# EasyEDA Pro project BLDCv5.eprj, schematic Schematic2_1
Board Name: SPDV4_THT; Create Date: 2024-11-05; Page Name: P1; Project Name: BLDCv5; Schematic Name: Schematic2_1; Update Date: 2024-12-21; Company: EasyEDA.com; Drawn: EasyEDA; Page Size: A4; Part Number: JLCPCB-002; Reviewed: EasyEDA; Version: V0.1
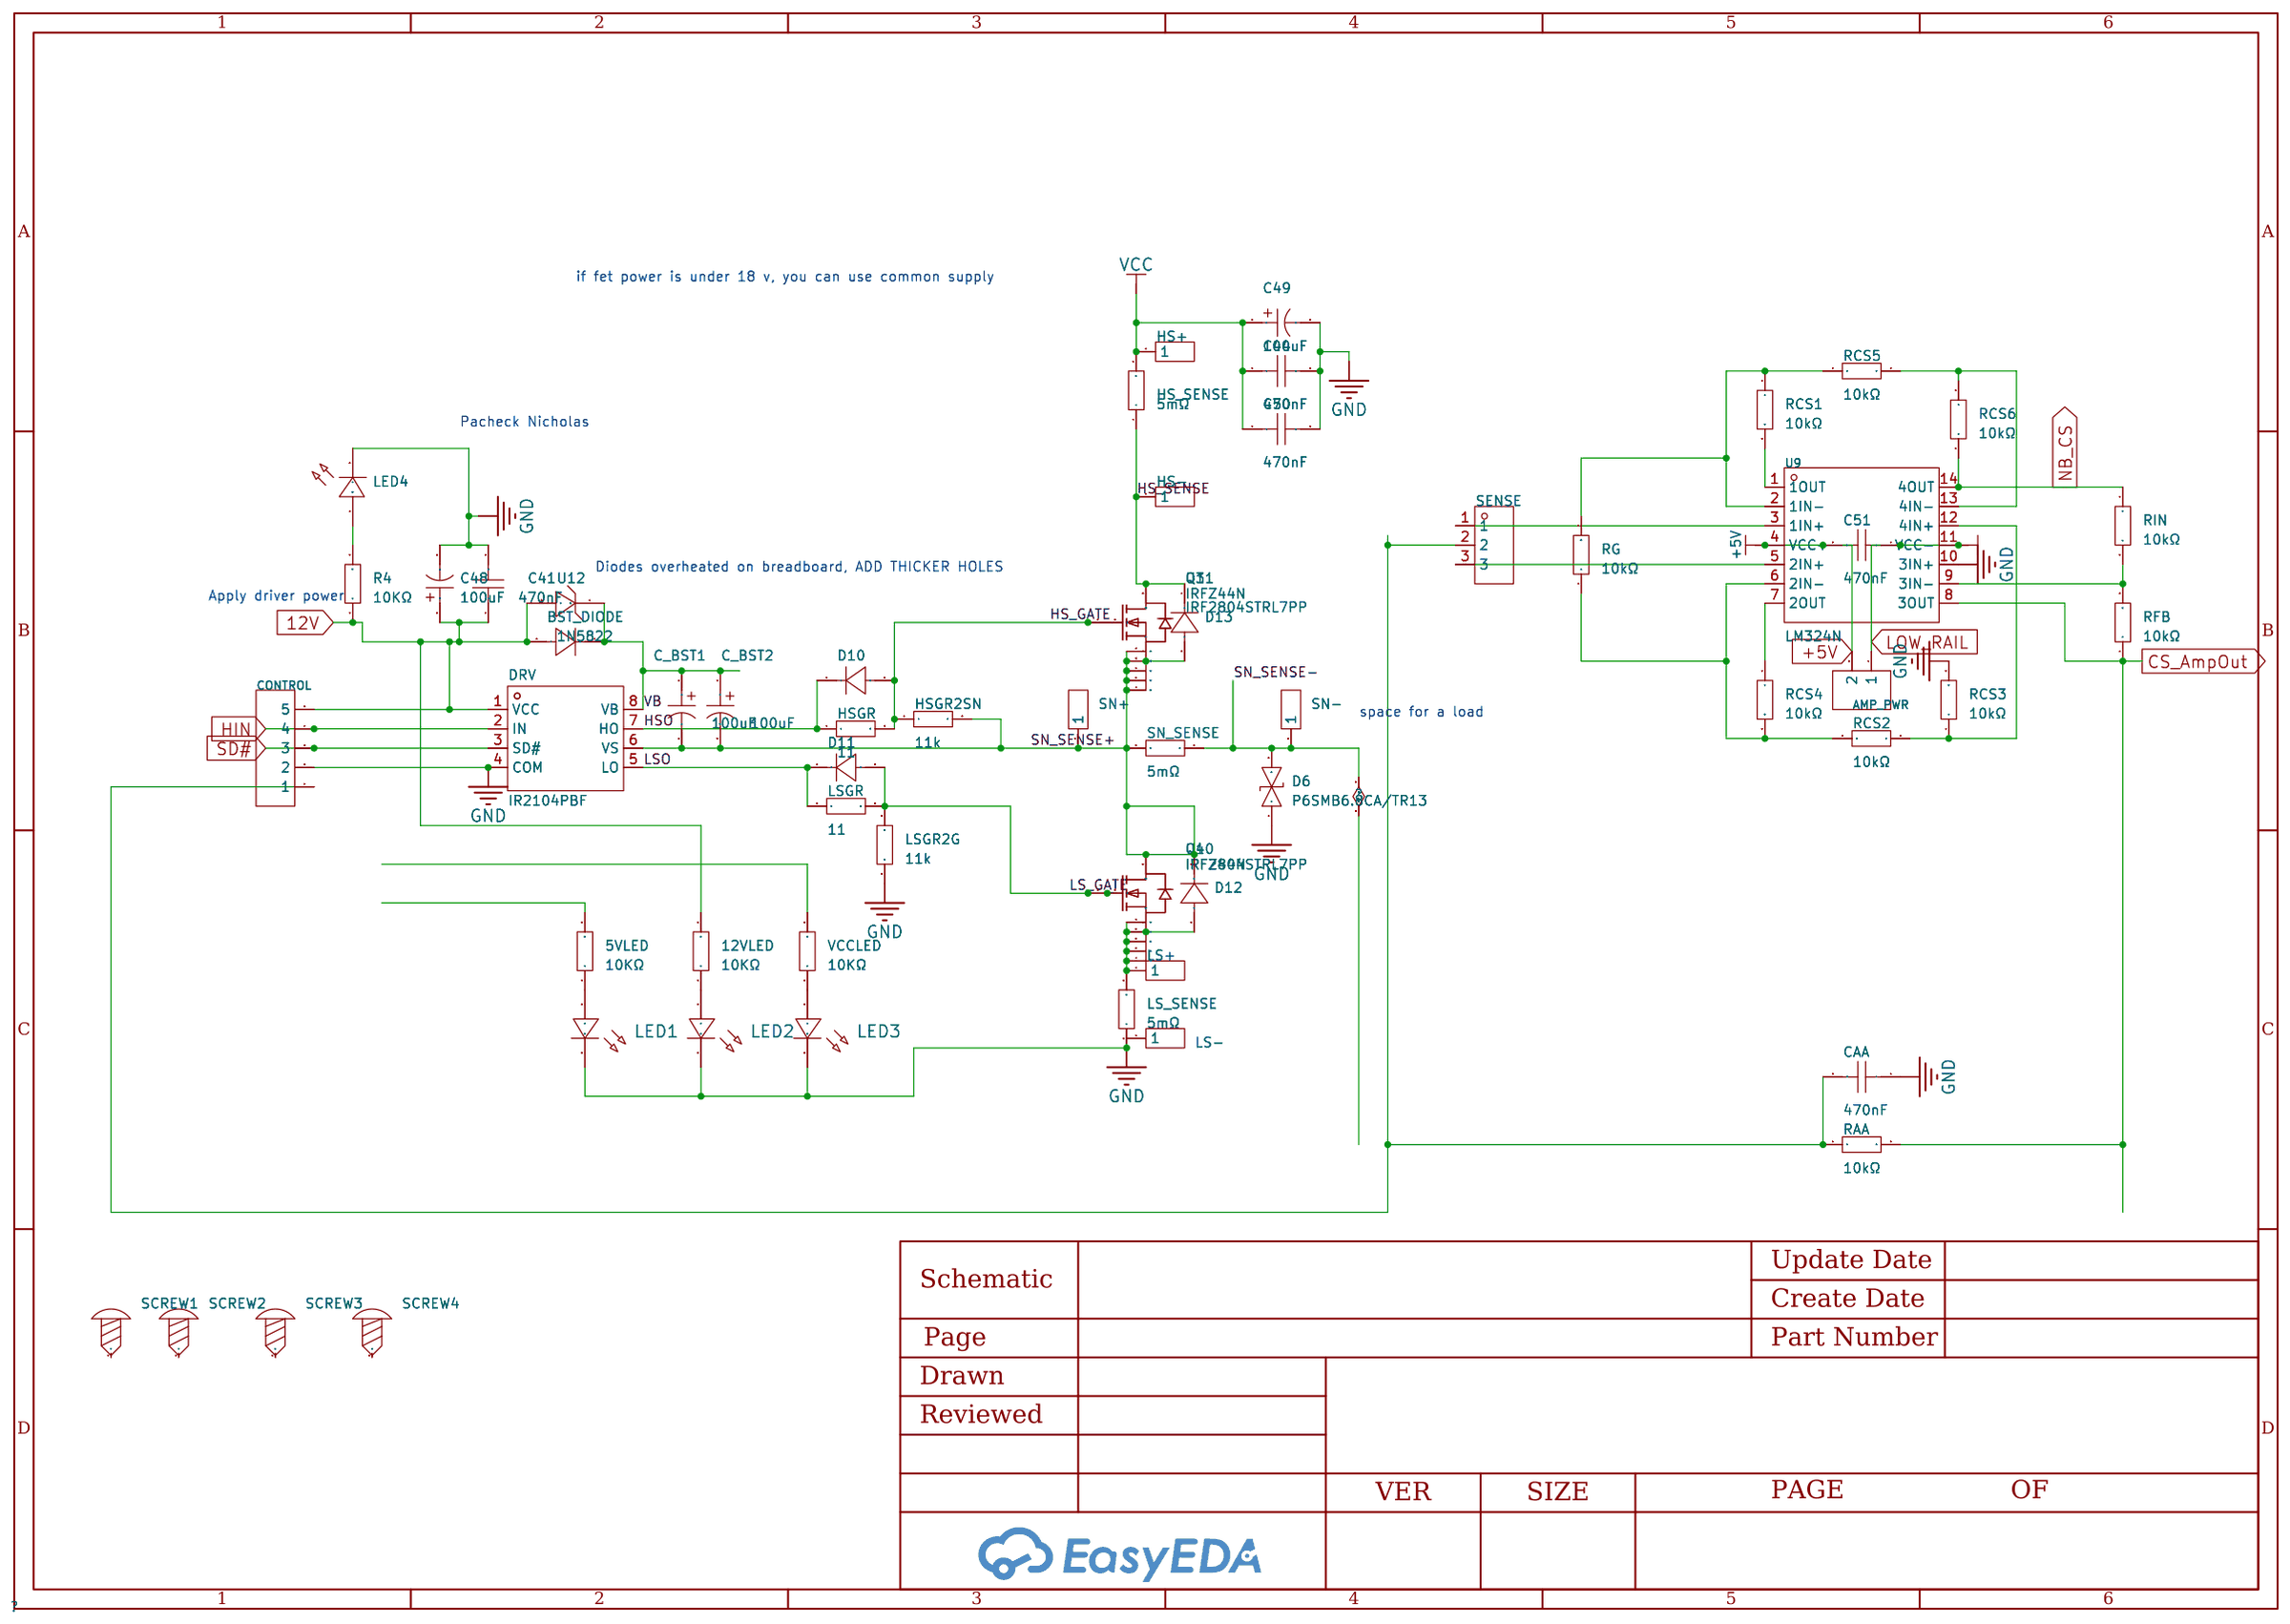
[diagram p4: schematic sheet]

## Parts
5VLED  10KΩ  [R1210]
12VLED  10KΩ  [R1210]
AMP_PWR  -  [HDR-TH_2P-P2.54-V-F]
BST_DIODE  -  [DO-41_BD2.4-L4.7-P8.70-D0.9-RD]
C41  470nF  [CAP-TH_L7.2-W2.5-P5.00-D0.5]
C44  470nF  [CAP-TH_L7.2-W2.5-P5.00-D0.5]
C48  100uF  [CAP-TH_BD8.0-P3.50-D0.6-FD]
C49  100uF  [CAP-TH_BD8.0-P3.50-D0.6-FD]
C50  470nF  [CAP-TH_L7.2-W2.5-P5.00-D0.5]
C51  470nF  [CAP-TH_L7.2-W2.5-P5.00-D0.5]
C_BST1  100uF  [CAP-TH_BD8.0-P3.50-D0.6-FD]
C_BST2  100uF  [CAP-TH_BD8.0-P3.50-D0.6-FD]
CAA  470nF  [CAP-TH_L7.2-W2.5-P5.00-D0.5]
CONTROL  -  [HDR-TH_5P-P2.54-V-F]
D6  P6SMB6.8CA/TR13  [SMB_L4.6-W3.6-LS5.3-BI]
D10  -  [DO-41_BD2.4-L4.7-P8.70-D0.9-RD]
D11  -  [DO-41_BD2.4-L4.7-P8.70-D0.9-RD]
D12  -  [DO-41_BD2.4-L4.7-P8.70-D0.9-RD]
D13  -  [DO-41_BD2.4-L4.7-P8.70-D0.9-RD]
DRV  IR2104PBF  [DIP-8_L9.9-W6.6-P2.54-LS7.62-BL]
HS+  -  [HDR-TH_1P-V-M_XKB_X4611WV-01I-C28D40]
HS-  -  [HDR-TH_1P-V-M_XKB_X4611WV-01I-C28D40]
HS_SENSE  5mΩ  [R2512]
HSGR  11  [RES-TH_BD3.3-L9.0-P13.00-D0.6]
HSGR2SN  11k  [RES-TH_BD3.3-L9.0-P13.00-D0.6]
LED1  -  [LED0805-RD_GREEN]
LED2  -  [LED0805-RD_GREEN]
LED3  -  [LED0805-RD_GREEN]
LED4  -  [LED-TH_BD3.0-P2.54-FD]
LS+  -  [HDR-TH_1P-V-M_XKB_X4611WV-01I-C28D40]
LS-  -  [HDR-TH_1P-V-M_XKB_X4611WV-01I-C28D40]
LS_SENSE  5mΩ  [R2512]
LSGR  11  [RES-TH_BD3.3-L9.0-P13.00-D0.6]
LSGR2G  11k  [RES-TH_BD3.3-L9.0-P13.00-D0.6]
Q3  IRF2804STRL7PP  [D2PAK-7_L10.6-W9.6-P1.27-LS15.9-BR]
Q4  IRF2804STRL7PP  [D2PAK-7_L10.6-W9.6-P1.27-LS15.9-BR]
R4  10KΩ  [R1210]
RAA  10kΩ  [R_AXIAL-0.4]
RCS1  10kΩ  [R_AXIAL-0.4]
RCS2  10kΩ  [R_AXIAL-0.4]
RCS3  10kΩ  [R_AXIAL-0.4]
RCS4  10kΩ  [R_AXIAL-0.4]
RCS5  10kΩ  [R_AXIAL-0.4]
RCS6  10kΩ  [R_AXIAL-0.4]
RFB  10kΩ  [R_AXIAL-0.4]
RG  10kΩ  [R_AXIAL-0.4]
RIN  10kΩ  [R_AXIAL-0.4]
SCREW1  -  [Screw-Hole-M4]
SCREW2  -  [Screw-Hole-M4]
SCREW3  -  [Screw-Hole-M4]
SCREW4  -  [Screw-Hole-M4]
SENSE  -  [HDR-TH_3P-P2.54-V-M]
SN+  -  [HDR-TH_1P-V-M_XKB_X4611WV-01I-C28D40]
SN-  -  [HDR-TH_1P-V-M_XKB_X4611WV-01I-C28D40]
SN_SENSE  5mΩ  [R2512]
U9  LM324N  [DIP-14_L19.3-W7.0-P2.54-LS7.6-BL]
U10  IRFZ44N  [TO-220-3_L9.9-W4.5-P2.54-L]
U11  IRFZ44N  [TO-220-3_L9.9-W4.5-P2.54-L]
U12  1N5822  [SMA_L4.3-W2.6-LS5.1-RD]
VCCLED  10KΩ  [R1210]

## Library data of the parts
5VLED 12VLED R4 VCCLED = Res_1210: Supplier Footprint: 1210
AMP_PWR = HDR-F_2.54_1x2P: Supplier Footprint: Through
BST_DIODE D10-D13 = 1N4007: Supplier Footprint: DO-41
C41 C44 C50 C51 CAA = C241J474J20C000: Capacitance:470nF Tolerance:±5% Tolerance:±5% Voltage Rated: Dielectric Material:Metallized Polyester Film Capacitor Operating Temperature:-55℃~+125℃ Operating Temperature:-55℃~+125℃; LCSC Part Name: 470nF ±5% 63V; Supplier Part: C5121927; Manufacturer: faratronic(厦门法拉); Supplier Footprint: 插件,P=5mm; JLCPCB Part Class: Extended Part; Datasheet: https://atta.szlcsc.com/upload/public/pdf/source/20220309/53E9D6585E584592026F1B9FCED89B93.pdf; Supplier: LCSC; Tolerance: ±5%; Dielectric Material: Metallized Polyester Film Capacitor; Operating Temperature: -55℃~+125℃
C48 C49 C_BST1 C_BST2 = EGT226M2AF12RR: Capacitance: Tolerance:±20% Tolerance:±20% Rated Voltage: Ripple Current:- Equivalent Series Resistance(ESR):- Lead Spacing: φD:- L:- Lifetime @ Temp:7000hrs@105℃ Operating Temperature:-45℃~+105℃ Operating Temperature:-45℃~+105℃; LCSC Part Name: 22uF ±20% 100V; Supplier Part: C840214; Manufacturer: MAN YUE(万裕科技); Supplier Footprint: 插件; JLCPCB Part Class: Extended Part; Datasheet: https://atta.szlcsc.com/upload/public/pdf/source/20181204/C235371_127DC39C6F805AD99E748A9DC446523D.pdf; Supplier: LCSC; Tolerance: ±20%; Lifetime @ Temp: 7000hrs@105℃; Operating Temperature: -45℃~+105℃
CONTROL = HDR-F_2.54_1x5P: Supplier Footprint: Through
D6 = P6SMB6.8CA/TR13: Reverse Stand-Off Voltage (Vrwm):5.8V Maximum Clamping Voltage:10.5V Peak Pulse Current (Ipp)@10/1000us:58.1A Peak Pulse Power Dissipation (Ppp)@10/1000us:600W Breakdown Voltage:6.45V Type:TVS; Supplier Part: C78395; Manufacturer: Brightking(君耀电子); Supplier Footprint: SMB(DO-214AA); JLCPCB Part Class: Basic Part; Datasheet: https://atta.szlcsc.com/upload/public/pdf/source/20160709/1468031879762.pdf; Supplier: LCSC; Reverse Stand-Off Voltage (Vrwm): 5.8V; Maximum Clamping Voltage: 10.5V; Peak Pulse Current (Ipp)@10/1000us: 58.1A; Peak Pulse Power Dissipation (Ppp)@10/1000us: 600W; Breakdown Voltage: 6.45V; Type: TVS
DRV = IR2104PBF: Driven Configuration:Half Bridge Load Type:MOSFET；IGBT Number of Drivers:2 Peak Output Current(sink):360mA Peak Output Current(source):210mA Supply Voltage:10V~20V Supply Voltage:10V~20V Rise Time:100ns Fall Time:50ns Operating Temperature:-40℃~+150℃@(Tj); LCSC Part Name: IR2104PBF 停产; Supplier Part: C2959; Manufacturer: Infineon(英飞凌); Supplier Footprint: PDIP-8; JLCPCB Part Class: Extended Part; Datasheet: https://atta.szlcsc.com/upload/public/pdf/source/20140906/1457707236579.pdf; Supplier: LCSC; Driven Configuration: Half Bridge; Load Type: MOSFET；IGBT; Number of Drivers: 2; Peak Output Current(sink): 360mA; Peak Output Current(source): 210mA; Supply Voltage: 10V~20V; Rise Time: 100ns; Fall Time: 50ns; Operating Temperature: -40℃~+150℃@(Tj)
HS+ HS- LS+ LS- SN+ SN- = HDR-M_2.54_1x1P: Supplier Footprint: Through
HS_SENSE LS_SENSE SN_SENSE = PA2512FKF7W0R005E: Type:Current Sensing Resistors Resistance: Tolerance:±1% Tolerance:±1% Power(Watts): Temperature Coefficient:±100ppm/℃ Temperature Coefficient:±100ppm/℃; LCSC Part Name: 5mΩ ±1% 2W; Supplier Part: C309526; Manufacturer: YAGEO(国巨); Supplier Footprint: 2512; JLCPCB Part Class: Extended Part; Datasheet: https://atta.szlcsc.com/upload/public/pdf/source/20190227/C375693_219964CC8B3EBD36DBDF701587FA5938.pdf; Supplier: LCSC; Type: Current Sensing Resistors; Tolerance: ±1%; Temperature Coefficient: ±100ppm/℃
HSGR HSGR2SN LSGR LSGR2G = Res_AXIAL-1/2W: Supplier Footprint: Through
LED1-LED3 = LED_0805-R: Supplier Footprint: 0805
LED4 = LED_TH-R_3mm: Supplier Footprint: Through
Q3 Q4 = IRF2804STRL7PP: Supplier Part: C459950; Manufacturer: Infineon(英飞凌); Supplier Footprint: TO-252-3; JLCPCB Part Class: Extended Part; Datasheet: https://atta.szlcsc.com/upload/public/pdf/source/20211220/39CD65D483719D465F1A88FFAD2C5DF5.pdf; Supplier: LCSC
RAA RCS1-RCS6 RFB RG RIN = Res_AXIAL-1/4W: Supplier Footprint: Through
SCREW1-SCREW4 = Screw-Hole-M4: Supplier Footprint: 插件
SENSE = HDR-M_2.54_1x3P: Supplier Footprint: Through
U9 = LM324N_C114380: Number of Circuits:Quad Gain Bandwidth Product(GBP):1.2MHz Current - Input Bias(Ib):45nA Slew Rate(SR):- Output Current:40mA -3db Bandwidth:- Supply Current:1mA Operating Temperature:0℃~+70℃ Operating Temperature:0℃~+70℃; Supplier Part: C114380; Manufacturer: TI(德州仪器); Supplier Footprint: DIP-14; JLCPCB Part Class: Extended Part; Datasheet: https://www.ti.com/cn/lit/gpn/lm324; Supplier: LCSC; Number of Circuits: Quad; Gain Bandwidth Product(GBP): 1.2MHz; Current - Input Bias(Ib): 45nA; Output Current: 40mA; Supply Current: 1mA; Operating Temperature: 0℃~+70℃
U10 U11 = IRFZ44N: Type:1个NChannel Drain Source Voltage (Vdss):60V Continuous Drain Current (Id): Power Dissipation (Pd): Drain Source On Resistance (RDS(on)@Vgs,Id):12mΩ@10V,25A Gate Threshold Voltage (Vgs(th)@Id):3V@250uA Total Gate Charge (Qg@Vgs):31nC@10V Input Capacita; LCSC Part Name: 1个N沟道 耐压:60V 电流:60A; Supplier Part: C7429904; Manufacturer: minos(迈诺斯); Supplier Footprint: TO-220; JLCPCB Part Class: Extended Part; Datasheet: https://atta.szlcsc.com/upload/public/pdf/source/20230807/91A846AFF378822B6B73E3D1D52219D8.pdf; Supplier: LCSC; Type: 1个NChannel; Drain Source Voltage (Vdss): 60V; Drain Source On Resistance (RDS(on)@Vgs,Id): 12mΩ@10V,25A; Gate Threshold Voltage (Vgs(th)@Id): 3V@250uA; Total Gate Charge (Qg@Vgs): 31nC@10V; Input Capacitance (Ciss@Vds): 910pF@25V; Reverse Transfer Capacitance (Crss@Vds): 30pF@25V; Operating Temperature: -55℃~+175℃@(Tj)
U12 = 1N5822_C9900009641: Supplier Part: C9900009641; JLCPCB Part Class: Extended Part; Supplier: LCSC

## Nets
12V: 12VLED.2 BST_DIODE.2(A) C41.1 C48.1 CONTROL.5 DRV.1(VCC) R4.1 U12.2(A)
+5V: AMP_PWR.2 C51.2 U9.4(VCC+)
GND: C41.2 C44.2 C48.2 C49.2 C50.2 CAA.1 CONTROL.2 D6.1 DRV.4(COM) LED1.2(C) LED2.2(C) LED3.2(C) LED4.2(A) LS-.1 LS_SENSE.1 LSGR2G.1 RCS3.2 U9.10(3IN+)
VCC: C44.1 C49.1 C50.1 HS+.1 HS_SENSE.2
CS_AmpOut: RAA.2 RFB.1 U9.8(3OUT)
HIN: CONTROL.4 DRV.2(IN)
HS_GATE: D10.2(A) HSGR.2 HSGR2SN.1 Q3.1(G) U11.1(G)
HS_SENSE: D13.1(K) HS-.1 HS_SENSE.1 Q3.4(D) U11.2(D)
HSO: D10.1(K) DRV.7(HO) HSGR.1
LOW_RAIL: AMP_PWR.1 C51.1 U9.11(VCC-)
LS_GATE: D11.2(A) LSGR.2 LSGR2G.2 Q4.1(G) U10.1(G)
LSO: D11.1(K) DRV.5(LO) LSGR.1
NB_CS: RCS6.1 RIN.1 U9.14(4OUT)
SD#: CONTROL.3 DRV.3(SD#)
SN_SENSE+: C_BST1.2 C_BST2.2 D12.1(K) D13.2(A) DRV.6(VS) HSGR2SN.2 Q3.2(S) Q3.3(S) Q3.5(S) Q3.6(S) Q3.7(S) Q4.4(D) SN+.1 SN_SENSE.2 U10.2(D) U11.3(S)
SN_SENSE-: D6.2 SN-.1 SN_SENSE.1
VB: BST_DIODE.1(K) C_BST1.1 C_BST2.1 DRV.8(VB) U12.1(C)
$1N4671: D12.2(A) LS+.1 LS_SENSE.2 Q4.2(S) Q4.3(S) Q4.5(S) Q4.6(S) Q4.7(S) U10.3(S)
$1N9618: RCS1.2 U9.1(1OUT)
$1N9619: RCS4.1 U9.7(2OUT)
$1N9620: RCS2.1 RCS4.2 RG.1 U9.6(2IN-)
$1N9621: RCS1.1 RCS5.1 RG.2 U9.2(1IN-)
$1N9624: RCS2.2 RCS3.1 U9.12(4IN+)
$1N9626: RCS5.2 RCS6.2 U9.13(4IN-)
$1N9627: SENSE.1 U9.3(1IN+)
$1N9628: SENSE.3 U9.5(2IN+)
$1N9695: RFB.2 RIN.2 U9.9(3IN-)
$1N10131: CAA.2 CONTROL.1 RAA.1 SENSE.2
$1N10297: 5VLED.1 LED1.1(A)
$1N10323: 12VLED.1 LED2.1(A)
$1N10349: LED3.1(A) VCCLED.1
$1N10655: LED4.1(C) R4.2

Not connected (* = marked no-connect by the designer): 5VLED 2; SCREW1 1; SCREW2 1; SCREW3 1; SCREW4 1; VCCLED 2

## Notes on the sheet
- if fet power is under 18 v, you can use common supply
- Pacheck Nicholas
- Diodes overheated on breadboard, ADD THICKER HOLES
- Apply driver power
- space for a load
